# EasyEDA Pro project kuafu01_030内部老化方案.eprj, board PCB4 (continued)
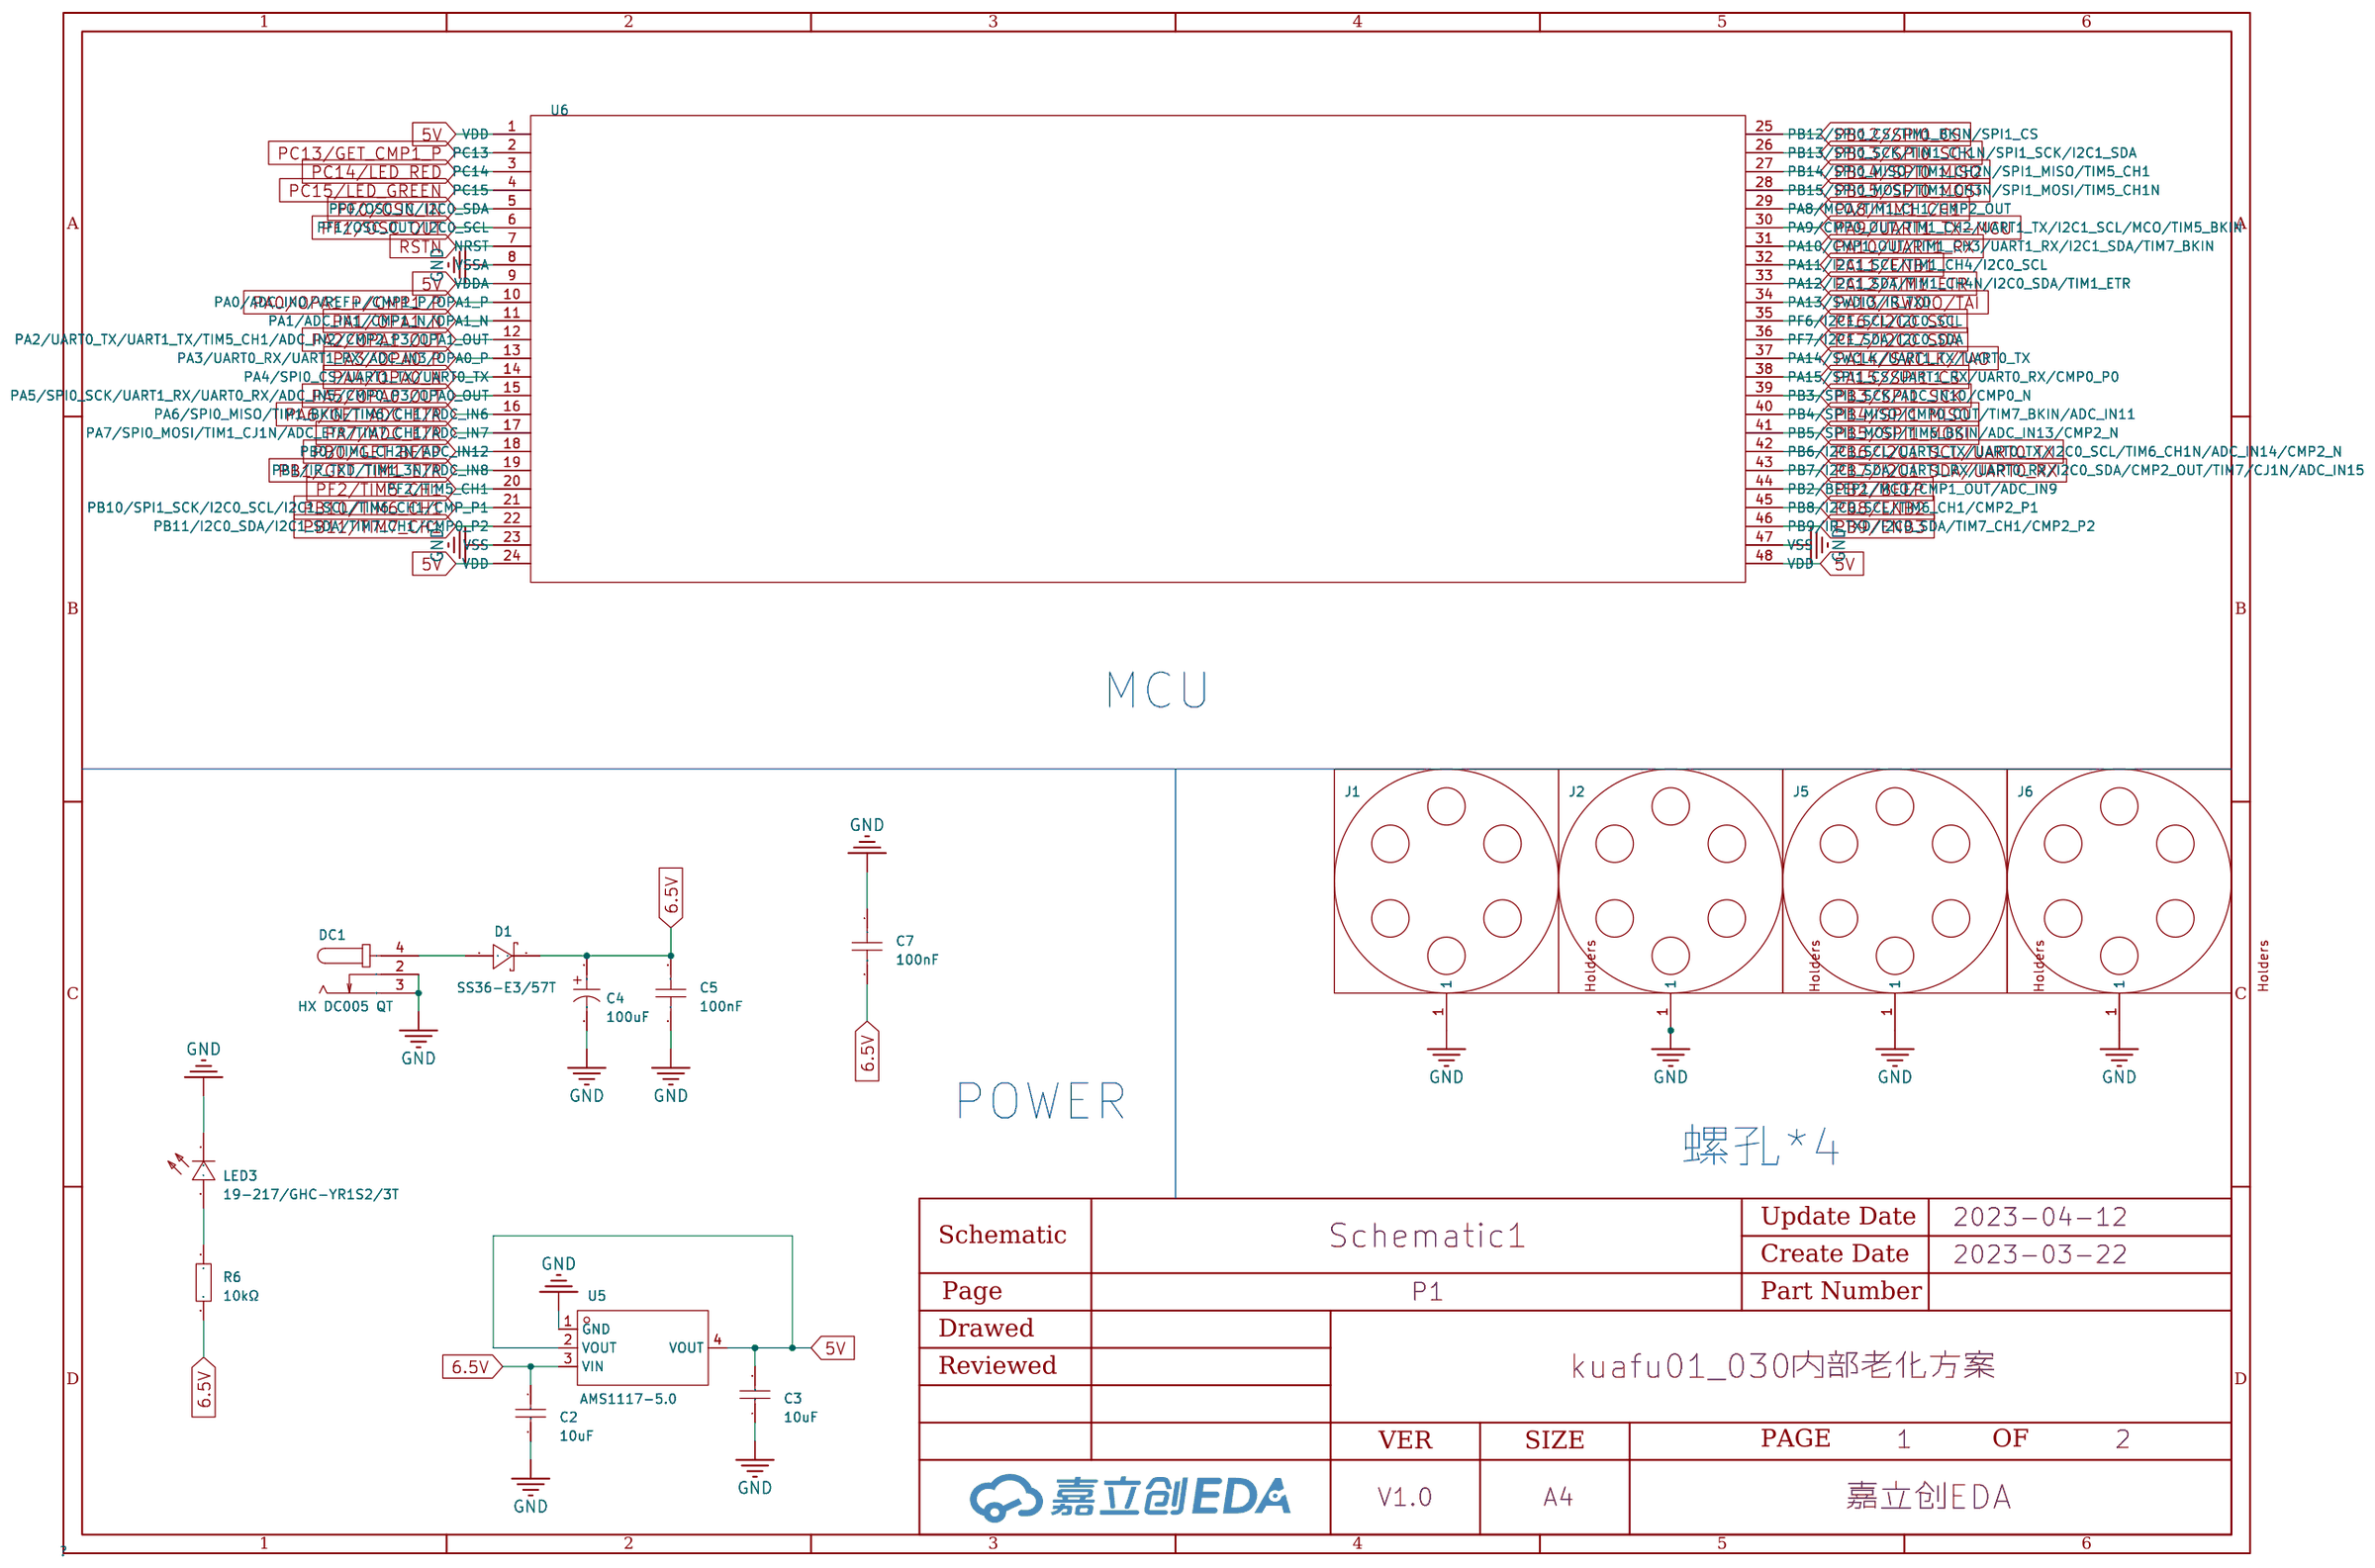
[diagram p0: P1]
## Routing (per net, layer and track width the routed paths; a pad name or vN(x,y) marks a point on that pad's centre or on a via; arc(x,y) is an arc through that point) (continued)
  Top Layer w0.508: 52.86,202.19 52.89,202.21 v1(52.89,205.81) ; 300.72,268.99 300.73,268.48 299.9,267.65 298.76,267.65 297.27,269.14 297.27,269.18 296.35,270.1 ; 300.72,268.99 300.72,268.97 ; 300.72,268.99 300.72,269.78 301.51,270.58 ; v1(254.79,250.36) 254.81,250.38 255.57,250.38 255.98,250.79 255.98,252.86 ; v1(66.08,319.86) 68.12,319.86 ; 68.12,319.86 68.12,323.17 C3#4.1 68.08,332.78 U5#3.1 ; 68.12,319.86 72.18,319.86 75.22,322.91 v1(75.22,347.8) ; v1(240.77,177.09) 239.62,178.25 239.62,178.28 ; v1(316.56,182.93) 316.25,183.24 315.44,183.24 ; 190.21,180.86 191.28,180.86 191.81,180.32 v1(192.5,180.32) ; 42.34,171.52 42.34,168.48 ; v1(203.99,250.36) 204.01,250.38 204.77,250.38 205.18,250.79 205.18,252.86 ; 245.54,222.32 245.54,219.28 ; 241.01,333.26 242.08,333.26 242.61,332.72 v1(243.3,332.72) ; v1(37.57,24.69) 36.42,25.85 36.42,25.88 ; 154.38,202.06 154.38,199.99 153.97,199.58 153.21,199.58 v1(153.19,199.56) ; 249.75,143.12 249.75,143.44 v1(248.89,144.29) ; v1(294.1,231.12) 293.41,231.12 292.88,231.66 291.81,231.66 ; 154.38,252.86 154.38,250.79 153.97,250.38 153.21,250.38 v1(153.19,250.36) ; 154.38,100.46 154.38,98.39 153.97,97.98 153.21,97.98 v1(153.19,97.96) ; 163.04,284.84 163.85,284.84 v1(164.16,284.53) ; 46.55,143.12 46.55,143.44 v1(45.69,144.29) ; 61.44,132.44 62.25,132.44 v1(62.56,132.13) ; 241.01,180.86 242.08,180.86 242.61,180.32 v1(243.3,180.32) ; 249.92,167.39 249.93,166.88 249.1,166.05 247.96,166.05 246.47,167.54 246.47,167.57 245.55,168.5 ; 249.92,167.39 249.92,168.18 250.71,168.98 ; 249.92,167.39 249.92,167.37 ; 199.12,218.19 199.13,217.68 198.3,216.85 197.16,216.85 195.67,218.34 195.67,218.38 194.75,219.3 ; 199.12,218.19 199.12,218.17 ; 199.12,218.19 199.12,218.98 199.91,219.78 ; 52.78,151.26 52.78,149.19 52.37,148.78 51.61,148.78 v1(51.59,148.76) ; 93.15,117.7 94.07,116.77 94.07,116.74 95.56,115.25 96.7,115.25 97.53,116.08 97.52,116.59 ; 97.52,14.99 97.52,14.97 ; 97.52,14.99 97.52,15.78 98.31,16.58 ; 97.52,14.99 97.53,14.48 96.7,13.65 95.56,13.65 94.07,15.14 94.07,15.18 93.15,16.1 ; 245.54,117.68 245.54,120.72 ; 198.95,143.12 198.95,143.44 v1(198.09,144.29) ; 154.46,100.59 154.49,100.61 v1(154.49,104.21) ; 213.84,284.84 214.65,284.84 v1(214.96,284.53) ; 93.14,270.08 93.14,273.12 ; 163.04,81.64 163.85,81.64 v1(164.16,81.33) ; 205.26,303.79 205.29,303.81 v1(205.29,307.41) ; 291.81,79.26 292.88,79.26 293.41,78.72 v1(294.1,78.72) ; 97.52,116.59 97.52,116.57 ; 97.52,116.59 97.52,117.38 98.31,118.18 ; v1(305.59,199.56) 305.61,199.58 306.37,199.58 306.78,199.99 306.78,202.06 ; 46.72,167.39 46.73,166.88 45.9,166.05 44.76,166.05 43.27,167.54 43.27,167.57 42.35,168.5 ; 46.72,167.39 46.72,167.37 ; 46.72,167.39 46.72,168.18 47.51,168.98 ; v1(256.09,205.81) 256.09,202.21 256.06,202.19 ; 148.32,14.99 148.32,14.97 ; 148.32,14.99 148.32,15.78 149.11,16.58 ; 148.32,14.99 148.33,14.48 147.5,13.65 146.36,13.65 144.87,15.14 144.87,15.18 143.95,16.1 ; 93.15,270.1 94.07,269.18 94.07,269.14 95.56,267.65 96.7,267.65 97.53,268.48 97.52,268.99 ; v1(139.17,227.89) 138.02,229.05 138.02,229.08 ; v1(153.19,47.16) 153.21,47.18 153.97,47.18 154.38,47.59 154.38,49.66 ; 306.78,151.26 306.78,149.19 306.37,148.78 305.61,148.78 v1(305.59,148.76) ; 57.38,341.38 54.72,341.38 ; 57.38,341.38 59.74,341.38 ; 57.38,341.38 57.38,341.38 57.38,348.52 ; 54.72,341.38 54.72,341.38 54.72,352.37 ; 54.72,341.38 40.36,341.38 37.12,344.61 37.18,349.29 ; 249.92,14.99 249.92,14.97 ; 249.92,14.99 249.93,14.48 249.1,13.65 247.96,13.65 246.47,15.14 246.47,15.18 245.55,16.1 ; 249.92,14.99 249.92,15.78 250.71,16.58 ; 148.32,218.19 148.32,218.98 149.11,219.78 ; 148.32,218.19 148.32,218.17 ; 148.32,218.19 148.33,217.68 147.5,216.85 146.36,216.85 144.87,218.34 144.87,218.38 143.95,219.3 ; v1(193.75,334.87) 195.33,334.87 v1(196.29,333.91) ; v1(139.17,75.49) 138.02,76.65 138.02,76.68 ; v1(256.09,358.21) 256.09,354.61 256.06,354.59 ; 300.54,193.92 300.54,194.24 v1(299.69,195.09) ; 306.86,100.59 306.89,100.61 v1(306.89,104.21) ; v1(254.79,199.56) 254.81,199.58 255.57,199.58 255.98,199.99 255.98,202.06 ; v1(193.75,284.07) 195.33,284.07 v1(196.29,283.11) ; 199.91,168.98 199.12,168.18 199.12,167.39 ; v1(139.17,177.09) 138.02,178.25 138.02,178.28 ; 301.51,67.38 300.72,66.58 300.72,65.79 ; 194.74,120.72 194.74,117.68 ; 296.35,117.7 297.27,116.77 297.27,116.74 298.76,115.25 299.9,115.25 300.73,116.08 300.72,116.59 ; v1(295.35,182.47) 296.93,182.47 v1(297.89,181.51) ; 315.44,284.84 316.25,284.84 v1(316.56,284.53) ; 205.18,303.66 205.18,301.59 204.77,301.18 204.01,301.18 v1(203.99,301.16) ; 194.74,171.52 194.74,168.48 ; 148.32,268.99 148.33,268.48 147.5,267.65 146.36,267.65 144.87,269.14 144.87,269.18 143.95,270.1 ; 148.32,268.99 148.32,268.97 ; 148.32,268.99 148.32,269.78 149.11,270.58 ; v1(90.9,129.52) 90.21,129.52 89.67,130.06 88.61,130.06 ; 97.52,268.99 97.52,268.97 ; 97.52,268.99 97.52,269.78 98.31,270.58 ; 296.34,117.68 296.34,120.72 ; 300.72,319.79 300.72,319.77 ; 300.72,319.79 300.73,319.28 299.9,318.45 298.76,318.45 297.27,319.94 297.27,319.97 296.35,320.9 ; 300.72,319.79 300.72,320.58 301.51,321.38 ; 255.98,49.66 255.98,47.59 255.57,47.18 254.81,47.18 v1(254.79,47.16) ; v1(139.17,278.69) 138.02,279.85 138.02,279.88 ; 194.74,219.28 194.74,222.32 ; 88.61,282.46 89.67,282.46 90.21,281.92 v1(90.9,281.92) ; 93.14,66.88 93.14,69.92 ; v1(103.69,307.41) 103.69,303.81 103.66,303.79 ; 52.86,151.39 52.89,151.41 v1(52.89,155.01) ; 239.62,330.68 239.62,330.65 v1(240.77,329.49) ; v1(244.55,284.07) 246.13,284.07 v1(247.09,283.11) ; 138.02,25.88 138.02,25.85 v1(139.17,24.69) ; v1(103.69,53.41) 103.69,49.81 103.66,49.79 ; v1(205.29,205.81) 205.29,202.21 205.26,202.19 ; 46.72,116.59 46.72,117.38 47.51,118.18 ; 46.72,116.59 46.72,116.57 ; 46.72,116.59 46.73,116.08 45.9,115.25 44.76,115.25 43.27,116.74 43.27,116.77 42.35,117.7 ; 143.95,168.5 144.87,167.57 144.87,167.54 146.36,166.05 147.5,166.05 148.33,166.88 148.32,167.39 ; 199.12,268.99 199.13,268.48 198.3,267.65 197.16,267.65 195.67,269.14 195.67,269.18 194.75,270.1 ; 199.12,268.99 199.12,268.97 ; 199.12,268.99 199.12,269.78 199.91,270.58 ; 103.58,202.06 103.58,199.99 103.17,199.58 102.41,199.58 v1(102.39,199.56) ; 250.71,67.38 249.92,66.58 249.92,65.79 ; v1(192.5,78.72) 191.81,78.72 191.28,79.26 190.21,79.26 ; 97.52,167.39 97.53,166.88 96.7,166.05 95.56,166.05 94.07,167.54 94.07,167.57 93.15,168.5 ; 97.52,167.39 97.52,168.18 98.31,168.98 ; 97.52,167.39 97.52,167.37 ; v1(297.89,79.91) 296.93,80.87 v1(295.35,80.87) ; v1(306.89,256.61) 306.89,253.01 306.86,252.99 ; v1(90.9,27.92) 90.21,27.92 89.67,28.46 88.61,28.46 ; v1(247.09,333.91) 246.13,334.87 v1(244.55,334.87) ; 97.34,193.92 97.34,194.24 v1(96.49,195.09) ; 148.32,167.39 148.32,167.37 ; 148.32,167.39 148.32,168.18 149.11,168.98 ; 163.04,30.84 163.85,30.84 v1(164.16,30.53) ; v1(256.09,155.01) 256.09,151.41 256.06,151.39 ; v1(43.89,283.11) 42.93,284.07 v1(41.35,284.07) ; 249.92,218.19 249.93,217.68 249.1,216.85 247.96,216.85 246.47,218.34 246.47,218.38 245.55,219.3 ; 249.92,218.19 249.92,218.17 ; 249.92,218.19 249.92,218.98 250.71,219.78 ; 245.54,16.08 245.54,19.12 ; 93.14,320.88 93.14,323.92 ; 291.81,282.46 292.88,282.46 293.41,281.92 v1(294.1,281.92) ; 93.14,168.48 93.14,171.52 ; v1(145.49,130.71) 144.53,131.67 v1(142.95,131.67) ; v1(51.59,199.56) 51.61,199.58 52.37,199.58 52.78,199.99 52.78,202.06 ; v1(141.7,231.12) 141.01,231.12 140.47,231.66 139.41,231.66 ; v1(294.1,129.52) 293.41,129.52 292.88,130.06 291.81,130.06 ; 66.12,358.43 66.2,358.43 ; 66.12,358.43 37.48,358.43 34.09,355.04 ; 66.12,358.43 66.12,358.42 ; 66.2,358.43 66.14,358.38 ; 66.2,358.43 67.03,358.43 ; 66.2,358.43 68.65,360.88 74.32,360.88 75.97,359.23 76.4,359.23 ; v1(196.29,181.51) 195.33,182.47 v1(193.75,182.47) ; v1(52.89,104.21) 52.89,100.61 52.86,100.59 ; v1(141.7,332.72) 141.01,332.72 140.47,333.26 139.41,333.26 ; 42.34,222.32 42.34,219.28 ; 61.44,81.64 62.25,81.64 v1(62.56,81.33) ; 87.22,279.88 87.22,279.85 v1(88.37,278.69) ; 52.54,319.86 52.54,323.39 C3#2.1 52.5,332.63 U5.1 ; 52.54,319.86 v1(50.33,319.86) ; 52.54,319.86 v1(63.54,319.86) ; v1(243.3,129.52) 242.61,129.52 242.08,130.06 241.01,130.06 ; 213.84,234.04 214.65,234.04 v1(214.96,233.73) ; v1(198.09,296.69) 198.95,295.84 198.95,295.52 ; 46.72,268.99 46.73,268.48 45.9,267.65 44.76,267.65 43.27,269.14 43.27,269.18 42.35,270.1 ; 46.72,268.99 46.72,268.97 ; 46.72,268.99 46.72,269.78 47.51,270.58 ; 143.95,117.7 144.87,116.77 144.87,116.74 146.36,115.25 147.5,115.25 148.33,116.08 148.32,116.59 ; v1(214.96,30.53) 214.65,30.84 213.84,30.84 ; 143.94,320.88 143.94,323.92 ; 37.81,282.46 38.88,282.46 39.41,281.92 v1(40.1,281.92) ; v1(243.3,281.92) 242.61,281.92 242.08,282.46 241.01,282.46 ; 112.24,132.44 113.05,132.44 v1(113.36,132.13) ; 300.72,65.79 300.73,65.28 299.9,64.45 298.76,64.45 297.27,65.94 297.27,65.97 296.35,66.9 ; 300.72,65.79 300.72,65.77 ; 198.95,193.92 198.95,194.24 v1(198.09,195.09) ; 62.54,350.58 62.54,350.58 62.54,350.58 62.54,350.58 ; 62.54,350.58 62.54,350.59 ; 46.72,218.19 46.72,218.17 ; 46.72,218.19 46.72,218.98 47.51,219.78 ; 46.72,218.19 46.73,217.68 45.9,216.85 44.76,216.85 43.27,218.34 43.27,218.38 42.35,219.3 ; 199.12,116.59 199.12,116.57 ; 199.12,116.59 199.13,116.08 198.3,115.25 197.16,115.25 195.67,116.74 195.67,116.77 194.75,117.7 ; 199.12,116.59 199.12,117.38 199.91,118.18 ; v1(40.1,231.12) 39.41,231.12 38.88,231.66 37.81,231.66 ; 300.54,92.32 300.54,92.64 v1(299.69,93.49) ; 256.06,252.99 256.09,253.01 v1(256.09,256.61) ; 264.64,335.64 265.45,335.64 v1(265.76,335.33) ; v1(316.56,233.73) 316.25,234.04 315.44,234.04 ; v1(153.19,301.16) 153.21,301.18 153.97,301.18 154.38,301.59 154.38,303.66 ; v1(102.39,250.36) 102.41,250.38 103.17,250.38 103.58,250.79 103.58,252.86 ; v1(247.09,232.31) 246.13,233.27 v1(244.55,233.27) ; 139.41,282.46 140.47,282.46 141.01,281.92 v1(141.7,281.92) ; 300.72,218.19 300.72,218.98 301.51,219.78 ; 300.72,218.19 300.73,217.68 299.9,216.85 298.76,216.85 297.27,218.34 297.27,218.38 296.35,219.3 ; 300.72,218.19 300.72,218.17 ; 62.54,350.59 62.54,350.6 62.55,350.6 62.54,350.59 ; v1(248.89,42.69) 249.75,41.84 249.75,41.52 ; v1(52.89,53.41) 52.89,49.81 52.86,49.79 ; 143.94,120.72 143.94,117.68 ; 249.92,319.79 249.92,320.58 250.71,321.38 ; 249.92,319.79 249.92,319.77 ; 249.92,319.79 249.93,319.28 249.1,318.45 247.96,318.45 246.47,319.94 246.47,319.97 245.55,320.9 ; 249.92,116.59 249.92,116.57 ; 249.92,116.59 249.92,117.38 250.71,118.18 ; 249.92,116.59 249.93,116.08 249.1,115.25 247.96,115.25 246.47,116.74 246.47,116.77 245.55,117.7 ; v1(102.39,351.96) 102.41,351.98 103.17,351.98 103.58,352.39 103.58,354.46 ; v1(297.89,130.71) 296.93,131.67 v1(295.35,131.67) ; 306.86,151.39 306.89,151.41 v1(306.89,155.01) ; 296.34,69.92 296.34,66.88 ; 103.66,354.59 103.69,354.61 v1(103.69,358.21) ; v1(103.69,104.21) 103.69,100.61 103.66,100.59 ; 46.72,65.79 46.72,66.58 47.51,67.38 ; 46.72,65.79 46.72,65.77 ; 46.72,65.79 46.73,65.28 45.9,64.45 44.76,64.45 43.27,65.94 43.27,65.97 42.35,66.9 ; 42.34,19.12 42.34,16.08 ; 249.92,65.79 249.93,65.28 249.1,64.45 247.96,64.45 246.47,65.94 246.47,65.97 245.55,66.9 ; 249.92,65.79 249.92,65.77 ; v1(205.29,53.41) 205.29,49.81 205.26,49.79 ; 143.94,222.32 143.94,219.28 ; 194.74,16.08 194.74,19.12 ; 290.42,279.88 290.42,279.85 v1(291.57,278.69) ; v1(203.99,148.76) 204.01,148.78 204.77,148.78 205.18,149.19 205.18,151.26 ; 255.98,100.46 255.98,98.39 255.57,97.98 254.81,97.98 v1(254.79,97.96) ; v1(45.69,93.49) 46.55,92.64 46.55,92.32 ; 239.62,229.08 239.62,229.05 v1(240.77,227.89) ; v1(316.56,132.13) 316.25,132.44 315.44,132.44 ; 42.34,120.72 42.34,117.68 ; 306.78,100.46 306.78,98.39 306.37,97.98 305.61,97.98 v1(305.59,97.96) ; v1(295.35,233.27) 296.93,233.27 v1(297.89,232.31) ; 199.12,167.39 199.13,166.88 198.3,166.05 197.16,166.05 195.67,167.54 195.67,167.57 194.75,168.5 ; 199.12,167.39 199.12,167.37 ; 148.32,65.79 148.32,65.77 ; 148.32,65.79 148.32,66.58 149.11,67.38 ; 148.32,65.79 148.33,65.28 147.5,64.45 146.36,64.45 144.87,65.94 144.87,65.97 143.95,66.9 ; 213.84,132.44 214.65,132.44 v1(214.96,132.13) ; v1(90.9,332.72) 90.21,332.72 89.67,333.26 88.61,333.26 ; 42.34,66.88 42.34,69.92 ; 213.84,81.64 214.65,81.64 v1(214.96,81.33) ; 88.61,231.66 89.67,231.66 90.21,231.12 v1(90.9,231.12) ; v1(316.56,335.33) 316.25,335.64 315.44,335.64 ; v1(295.35,284.07) 296.93,284.07 v1(297.89,283.11) ; v1(37.57,278.69) 36.42,279.85 36.42,279.88 ; v1(103.69,155.01) 103.69,151.41 103.66,151.39 ; 194.75,16.1 195.67,15.18 195.67,15.14 197.16,13.65 198.3,13.65 199.13,14.48 199.12,14.99 ; 52.78,49.66 52.78,47.59 52.37,47.18 51.61,47.18 v1(51.59,47.16) ; v1(154.49,256.61) 154.49,253.01 154.46,252.99 ; 143.94,19.12 143.94,16.08 ; 205.18,202.06 205.18,199.99 204.77,199.58 204.01,199.58 v1(203.99,199.56) ; 143.94,171.52 143.94,168.48 ; 194.74,270.08 194.74,273.12 ; v1(145.49,79.91) 144.53,80.87 v1(142.95,80.87) ; 249.75,193.92 249.75,194.24 v1(248.89,195.09) ; v1(113.36,30.53) 113.05,30.84 112.24,30.84 ; 37.18,349.29 37.18,349.71 33.91,352.98 33.91,353.7 ; 37.18,349.29 37.18,349.18 37.22,349.14 ; v1(41.35,30.07) 42.93,30.07 v1(43.89,29.11) ; 198.95,346.32 198.95,346.64 v1(198.09,347.49) ; v1(248.89,347.49) 249.75,346.64 249.75,346.32 ; 148.32,319.79 148.32,319.77 ; 148.32,319.79 148.33,319.28 147.5,318.45 146.36,318.45 144.87,319.94 144.87,319.97 143.95,320.9 ; 148.32,319.79 148.32,320.58 149.11,321.38 ; 296.34,323.92 296.34,320.88 ; 42.34,270.08 42.34,273.12 ; v1(45.69,245.89) 46.55,245.04 46.55,244.72 ; 300.54,295.52 300.54,295.84 v1(299.69,296.69) ; v1(92.15,284.07) 93.73,284.07 v1(94.69,283.11) ; 36.42,76.68 36.42,76.65 v1(37.57,75.49) ; 205.26,151.39 205.29,151.41 v1(205.29,155.01) ; 42.35,16.1 43.27,15.18 43.27,15.14 44.76,13.65 45.9,13.65 46.73,14.48 46.72,14.99 ; 46.55,41.52 46.55,41.84 v1(45.69,42.69) ; 148.32,116.59 148.32,117.38 149.11,118.18 ; 148.32,116.59 148.32,116.57 ; 148.15,41.52 148.15,41.84 v1(147.29,42.69) ; v1(145.49,333.91) 144.53,334.87 v1(142.95,334.87) ; 194.74,323.92 194.74,320.88 ; v1(154.49,307.41) 154.49,303.81 154.46,303.79 ; 138.02,127.48 138.02,127.45 v1(139.17,126.29) ; v1(145.49,283.11) 144.53,284.07 v1(142.95,284.07) ; 256.06,49.79 256.09,49.81 v1(256.09,53.41) ; v1(192.5,281.92) 191.81,281.92 191.28,282.46 190.21,282.46 ; 264.64,81.64 265.45,81.64 v1(265.76,81.33) ; v1(306.89,205.81) 306.89,202.21 306.86,202.19 ; 239.62,25.88 239.62,25.85 v1(240.77,24.69) ; v1(203.99,351.96) 204.01,351.98 204.77,351.98 205.18,352.39 205.18,354.46 ; v1(247.09,130.71) 246.13,131.67 v1(244.55,131.67) ; 213.84,335.64 214.65,335.64 v1(214.96,335.33) ; 301.51,168.98 300.72,168.18 300.72,167.39 ; 205.26,252.99 205.29,253.01 v1(205.29,256.61) ; v1(164.16,132.13) 163.85,132.44 163.04,132.44 ; 97.34,346.32 97.34,346.64 v1(96.49,347.49) ; v1(141.7,129.52) 141.01,129.52 140.47,130.06 139.41,130.06 ; v1(189.97,329.49) 188.82,330.65 188.82,330.68 ; v1(113.36,81.33) 113.05,81.64 112.24,81.64 ; v1(96.49,42.69) 97.34,41.84 97.34,41.52 ; 97.52,218.19 97.52,218.98 98.31,219.78 ; 97.52,218.19 97.53,217.68 96.7,216.85 95.56,216.85 94.07,218.34 94.07,218.38 93.15,219.3 ; 97.52,218.19 97.52,218.17 ; v1(103.69,256.61) 103.69,253.01 103.66,252.99 ; 61.44,30.84 62.25,30.84 v1(62.56,30.53) ; v1(316.56,81.33) 316.25,81.64 315.44,81.64 ; v1(265.76,233.73) 265.45,234.04 264.64,234.04 ; 199.12,319.79 199.13,319.28 198.3,318.45 197.16,318.45 195.67,319.94 195.67,319.97 194.75,320.9 ; 199.12,319.79 199.12,319.77 ; 199.12,319.79 199.12,320.58 199.91,321.38 ; v1(52.89,256.61) 52.89,253.01 52.86,252.99 ; v1(40.1,78.72) 39.41,78.72 38.88,79.26 37.81,79.26 ; 103.58,49.66 103.58,47.59 103.17,47.18 102.41,47.18 v1(102.39,47.16) ; 300.54,143.12 300.54,143.44 v1(299.69,144.29) ; v1(92.15,334.87) 93.73,334.87 v1(94.69,333.91) ; v1(244.55,30.07) 246.13,30.07 v1(247.09,29.11) ; v1(254.79,351.96) 254.81,351.98 255.57,351.98 255.98,352.39 255.98,354.46 ; v1(41.35,182.47) 42.93,182.47 v1(43.89,181.51) ; 264.64,183.24 265.45,183.24 v1(265.76,182.93) ; v1(244.55,80.87) 246.13,80.87 v1(247.09,79.91) ; 296.35,168.5 297.27,167.57 297.27,167.54 298.76,166.05 299.9,166.05 300.73,166.88 300.72,167.39 ; v1(103.69,205.81) 103.69,202.21 103.66,202.19 ; 301.51,118.18 300.72,117.38 300.72,116.59 ; 143.94,66.88 143.94,69.92 ; 213.84,183.24 214.65,183.24 v1(214.96,182.93) ; v1(40.1,180.32) 39.41,180.32 38.88,180.86 37.81,180.86 ; 112.24,183.24 113.05,183.24 v1(113.36,182.93) ; 139.41,79.26 140.47,79.26 141.01,78.72 v1(141.7,78.72) ; 199.12,65.79 199.13,65.28 198.3,64.45 197.16,64.45 195.67,65.94 195.67,65.97 194.75,66.9 ; 199.12,65.79 199.12,66.58 199.91,67.38 ; 199.12,65.79 199.12,65.77 ; v1(45.69,195.09) 46.55,194.24 46.55,193.92 ; 112.24,335.64 113.05,335.64 v1(113.36,335.33) ; v1(88.37,75.49) 87.22,76.65 87.22,76.68 ; v1(145.49,29.11) 144.53,30.07 v1(142.95,30.07) ; 61.44,183.24 62.25,183.24 v1(62.56,182.93) ; 87.22,25.88 87.22,25.85 v1(88.37,24.69) ; 205.18,49.66 205.18,47.59 204.77,47.18 204.01,47.18 v1(203.99,47.16) ; v1(254.79,301.16) 254.81,301.18 255.57,301.18 255.98,301.59 255.98,303.66 ; v1(193.75,30.07) 195.33,30.07 v1(196.29,29.11) ; 148.15,295.52 148.15,295.84 v1(147.29,296.69) ; 112.24,284.84 113.05,284.84 v1(113.36,284.53) ; v1(189.97,126.29) 188.82,127.45 188.82,127.48 ; v1(51.59,301.16) 51.61,301.18 52.37,301.18 52.78,301.59 52.78,303.66 ; 37.81,28.46 38.88,28.46 39.41,27.92 v1(40.1,27.92) ; 52.86,303.79 52.89,303.81 v1(52.89,307.41) ; v1(154.49,155.01) 154.49,151.41 154.46,151.39 ; v1(145.49,181.51) 144.53,182.47 v1(142.95,182.47) ; v1(189.97,278.69) 188.82,279.85 188.82,279.88 ; 52.78,252.86 52.78,250.79 52.37,250.38 51.61,250.38 v1(51.59,250.36) ; 245.54,168.48 245.54,171.52 ; 306.86,354.59 306.89,354.61 v1(306.89,358.21) ; v1(265.76,284.53) 265.45,284.84 264.64,284.84 ; v1(88.37,227.89) 87.22,229.05 87.22,229.08 ; 46.55,295.52 46.55,295.84 v1(45.69,296.69) ; 256.06,100.59 256.09,100.61 v1(256.09,104.21) ; v1(193.75,233.27) 195.33,233.27 v1(196.29,232.31) ; 245.54,69.92 245.54,66.88 ; 198.95,41.52 198.95,41.84 v1(198.09,42.69) ; v1(203.99,97.96) 204.01,97.98 204.77,97.98 205.18,98.39 205.18,100.46 ; 148.15,143.12 148.15,143.44 v1(147.29,144.29) ; 62.54,350.57 62.54,350.57 62.54,342.8 61.12,341.38 59.74,341.38 ; v1(205.29,358.21) 205.29,354.61 205.26,354.59 ; v1(306.89,307.41) 306.89,303.81 306.86,303.79 ; v1(154.49,53.41) 154.49,49.81 154.46,49.79 ; v1(305.59,301.16) 305.61,301.18 306.37,301.18 306.78,301.59 306.78,303.66 ; 296.34,219.28 296.34,222.32 ; v1(96.49,144.29) 97.34,143.44 97.34,143.12 ; 249.92,268.99 249.92,268.97 ; 249.92,268.99 249.93,268.48 249.1,267.65 247.96,267.65 246.47,269.14 246.47,269.18 245.55,270.1 ; 249.92,268.99 249.92,269.78 250.71,270.58 ; 256.06,303.79 256.09,303.81 v1(256.09,307.41) ; v1(295.35,334.87) 296.93,334.87 v1(297.89,333.91) ; v1(37.57,177.09) 36.42,178.25 36.42,178.28 ; 245.54,273.12 245.54,270.08 ; 300.72,167.39 300.72,167.37 ; 290.42,229.08 290.42,229.05 v1(291.57,227.89) ; v1(96.49,245.89) 97.34,245.04 97.34,244.72 ; 148.15,193.92 148.15,194.24 v1(147.29,195.09) ; 97.52,319.79 97.53,319.28 96.7,318.45 95.56,318.45 94.07,319.94 94.07,319.97 93.15,320.9 ; 97.52,319.79 97.52,319.77 ; 97.52,319.79 97.52,320.58 98.31,321.38 ; v1(90.9,180.32) 90.21,180.32 89.67,180.86 88.61,180.86 ; 93.14,222.32 93.14,219.28 ; 190.21,130.06 191.28,130.06 191.81,129.52 v1(192.5,129.52) ; 194.74,66.88 194.74,69.92 ; v1(147.29,93.49) 148.15,92.64 148.15,92.32 ; 143.94,270.08 143.94,273.12 ; 291.81,180.86 292.88,180.86 293.41,180.32 v1(294.1,180.32) ; 148.15,244.72 148.15,245.04 v1(147.29,245.89) ; 198.95,92.32 198.95,92.64 v1(198.09,93.49) ; v1(192.5,332.72) 191.81,332.72 191.28,333.26 190.21,333.26 ; v1(254.79,148.76) 254.81,148.78 255.57,148.78 255.98,149.19 255.98,151.26 ; v1(43.89,232.31) 42.93,233.27 v1(41.35,233.27) ; v1(62.56,233.73) 62.25,234.04 61.44,234.04 ; 190.21,231.66 191.28,231.66 191.81,231.12 v1(192.5,231.12) ; 139.41,28.46 140.47,28.46 141.01,27.92 v1(141.7,27.92) ; v1(153.19,351.96) 153.21,351.98 153.97,351.98 154.38,352.39 154.38,354.46 ; v1(96.49,93.49) 97.34,92.64 97.34,92.32 ; v1(291.57,177.09) 290.42,178.25 290.42,178.28 ; v1(196.29,130.71) 195.33,131.67 v1(193.75,131.67) ; 290.42,127.48 290.42,127.45 v1(291.57,126.29) ; 296.34,273.12 296.34,270.08 ; v1(41.35,80.87) 42.93,80.87 v1(43.89,79.91) ; v1(92.15,233.27) 93.73,233.27 v1(94.69,232.31) ; 46.72,14.99 46.72,14.97 ; 46.72,14.99 46.72,15.78 47.51,16.58 ; v1(94.69,29.11) 93.73,30.07 v1(92.15,30.07) ; U5#4.1 36.82,332.79 C3.1 40.77,319.86 v1(47.79,319.86) ; 154.46,202.19 154.49,202.21 v1(154.49,205.81) ; 87.22,330.68 87.22,330.65 v1(88.37,329.49) ; v1(51.59,97.96) 51.61,97.98 52.37,97.98 52.78,98.39 52.78,100.46 ; 59.73,352.37 59.73,341.38 59.74,341.38 ; 300.54,244.72 300.54,245.04 v1(299.69,245.89) ; v1(88.37,126.29) 87.22,127.45 87.22,127.48 ; 87.22,178.28 87.22,178.25 v1(88.37,177.09) ; 98.31,67.38 97.52,66.58 97.52,65.79 ; 103.58,303.66 103.58,301.59 103.17,301.18 102.41,301.18 v1(102.39,301.16) ; v1(265.76,30.53) 265.45,30.84 264.64,30.84 ; 97.34,295.52 97.34,295.84 v1(96.49,296.69) ; 103.58,151.26 103.58,149.19 103.17,148.78 102.41,148.78 v1(102.39,148.76) ; v1(62.56,284.53) 62.25,284.84 61.44,284.84 ; 139.41,180.86 140.47,180.86 141.01,180.32 v1(141.7,180.32) ; 296.34,171.52 296.34,168.48 ; v1(291.57,329.49) 290.42,330.65 290.42,330.68 ; 249.75,244.72 249.75,245.04 v1(248.89,245.89) ; 205.26,100.59 205.29,100.61 v1(205.29,104.21) ; v1(92.15,80.87) 93.73,80.87 v1(94.69,79.91) ; v1(164.16,335.33) 163.85,335.64 163.04,335.64 ; v1(94.69,130.71) 93.73,131.67 v1(92.15,131.67) ; 37.81,130.06 38.88,130.06 39.41,129.52 v1(40.1,129.52) ; v1(154.49,358.21) 154.49,354.61 154.46,354.59 ; 198.95,244.72 198.95,245.04 v1(198.09,245.89) ; 239.62,127.48 239.62,127.45 v1(240.77,126.29) ; v1(243.3,78.72) 242.61,78.72 242.08,79.26 241.01,79.26 ; v1(153.19,148.76) 153.21,148.78 153.97,148.78 154.38,149.19 154.38,151.26 ; 300.72,116.59 300.72,116.57 ; v1(265.76,132.13) 265.45,132.44 264.64,132.44 ; 300.54,346.32 300.54,346.64 v1(299.69,347.49) ; 148.15,346.32 148.15,346.64 v1(147.29,347.49) ; v1(145.49,232.31) 144.53,233.27 v1(142.95,233.27) ; 190.21,28.46 191.28,28.46 191.81,27.92 v1(192.5,27.92) ; 188.82,178.28 188.82,178.25 v1(189.97,177.09) ; v1(90.9,78.72) 90.21,78.72 89.67,79.26 88.61,79.26 ; 245.54,320.88 245.54,323.92 ; 199.12,14.99 199.12,15.78 199.91,16.58 ; 199.12,14.99 199.12,14.97 ; 239.62,279.88 239.62,279.85 v1(240.77,278.69) ; v1(305.59,250.36) 305.61,250.38 306.37,250.38 306.78,250.79 306.78,252.86 ; v1(92.15,182.47) 93.73,182.47 v1(94.69,181.51) ; 163.04,183.24 163.85,183.24 v1(164.16,182.93) ; 97.52,65.79 97.53,65.28 96.7,64.45 95.56,64.45 94.07,65.94 94.07,65.97 93.15,66.9 ; 97.52,65.79 97.52,65.77 ; v1(102.39,97.96) 102.41,97.98 103.17,97.98 103.58,98.39 103.58,100.46 ; 112.24,234.04 113.05,234.04 v1(113.36,233.73) ; v1(41.35,131.67) 42.93,131.67 v1(43.89,130.71) ; 36.42,127.48 36.42,127.45 v1(37.57,126.29) ; v1(247.09,181.51) 246.13,182.47 v1(244.55,182.47) ; 291.81,333.26 292.88,333.26 293.41,332.72 v1(294.1,332.72) ; 249.75,92.32 249.75,92.64 v1(248.89,93.49) ; C3#3.1 81.28,359.19 v1(81.28,359.16) ; v1(37.57,227.89) 36.42,229.05 36.42,229.08 ; 239.62,76.68 239.62,76.65 v1(240.77,75.49) ; 306.78,354.46 306.78,352.39 306.37,351.98 305.61,351.98 v1(305.59,351.96) ; 241.01,28.46 242.08,28.46 242.61,27.92 v1(243.3,27.92) ; 93.14,120.72 93.14,117.68 ; 188.82,25.88 188.82,25.85 v1(189.97,24.69) ; v1(196.29,79.91) 195.33,80.87 v1(193.75,80.87) ; 163.04,234.04 163.85,234.04 v1(164.16,233.73) ; 188.82,229.08 188.82,229.05 v1(189.97,227.89) ; 290.42,76.68 290.42,76.65 v1(291.57,75.49) ; v1(139.17,329.49) 138.02,330.65 138.02,330.68 ; 249.75,295.52 249.75,295.84 v1(248.89,296.69) ; v1(243.3,231.12) 242.61,231.12 242.08,231.66 241.01,231.66 ; v1(189.97,75.49) 188.82,76.65 188.82,76.68 ; 93.14,19.12 93.14,16.08
  Bottom Layer w0.381: v1(95.11,242.04) 95.11,244.61 v1(98.94,248.43) ; v1(149.74,45.23) 145.91,41.41 v1(145.91,38.84) ; v1(251.34,45.23) 247.51,41.41 v1(247.51,38.84) ; v1(240.77,177.09) 241.71,176.16 241.71,174.77 v1(243.03,173.44) ; v1(148.01,36.37) 148.05,36.37 148.69,35.74 148.69,34.16 149.61,33.23 ; 251.21,287.23 250.29,288.16 250.29,289.74 249.65,290.37 v1(249.61,290.37) ; v1(44.31,89.64) 44.31,92.21 v1(48.13,96.03) ; v1(139.17,24.69) 140.11,23.76 140.11,22.37 v1(141.43,21.04) ; v1(249.61,188.77) 249.65,188.77 250.29,188.14 250.29,186.56 251.21,185.63 ; v1(46.41,239.57) 46.45,239.57 47.09,238.94 47.09,237.36 48.01,236.43 ; v1(192.23,71.84) 190.91,73.17 190.91,74.56 v1(189.97,75.49) ; v1(240.77,329.49) 241.71,328.56 241.71,327.17 v1(243.03,325.84) ; v1(39.83,122.64) 38.51,123.97 38.51,125.36 v1(37.57,126.29) ; v1(149.74,96.03) 145.91,92.21 v1(145.91,89.64) ; v1(95.11,292.84) 95.11,295.41 v1(98.94,299.23) ; v1(300.41,87.17) 300.45,87.17 301.09,86.54 301.09,84.96 302.01,84.03 ; v1(48.13,197.63) 44.31,193.81 v1(44.31,191.24) ; 302.01,236.43 301.09,237.36 301.09,238.94 300.45,239.57 v1(300.41,239.57) ; v1(139.17,329.49) 140.11,328.56 140.11,327.17 v1(141.43,325.84) ; v1(44.31,242.04) 44.31,244.61 v1(48.13,248.43) ; v1(300.41,341.17) 300.45,341.17 301.09,340.54 301.09,338.96 302.01,338.03 ; v1(240.77,278.69) 241.71,277.76 241.71,276.37 v1(243.03,275.04) ; v1(48.13,45.23) 44.31,41.41 v1(44.31,38.84) ; v1(196.71,89.64) 196.71,92.21 v1(200.53,96.03) ; v1(196.71,38.84) 196.71,41.41 v1(200.53,45.23) ; 200.41,287.23 199.49,288.16 199.49,289.74 198.85,290.37 v1(198.81,290.37) ; v1(37.57,227.89) 38.51,226.96 38.51,225.57 v1(39.83,224.24) ; 251.21,84.03 250.29,84.96 250.29,86.54 249.65,87.17 v1(249.61,87.17) ; v1(189.97,24.69) 190.91,23.76 190.91,22.37 v1(192.23,21.04) ; v1(298.31,191.24) 298.31,193.81 v1(302.13,197.63) ; v1(48.13,299.23) 44.31,295.41 v1(44.31,292.84) ; v1(240.77,227.89) 241.71,226.96 241.71,225.57 v1(243.03,224.24) ; v1(39.83,21.04) 38.51,22.37 38.51,23.76 v1(37.57,24.69) ; v1(247.51,191.24) 247.51,193.81 v1(251.34,197.63) ; v1(240.77,126.29) 241.71,125.36 241.71,123.97 v1(243.03,122.64) ; 98.81,338.03 97.89,338.96 97.89,340.54 97.25,341.17 v1(97.21,341.17) ; v1(139.17,126.29) 140.11,125.36 140.11,123.97 v1(141.43,122.64) ; v1(39.83,275.04) 38.51,276.37 38.51,277.76 v1(37.57,278.69) ; v1(97.21,290.37) 97.25,290.37 97.89,289.74 97.89,288.16 98.81,287.23 ; v1(149.74,299.23) 145.91,295.41 v1(145.91,292.84) ; 302.01,185.63 301.09,186.56 301.09,188.14 300.45,188.77 v1(300.41,188.77) ; v1(300.41,137.97) 300.45,137.97 301.09,137.34 301.09,135.76 302.01,134.83 ; v1(88.37,177.09) 89.31,176.16 89.31,174.77 v1(90.63,173.44) ; v1(200.53,299.23) 196.71,295.41 v1(196.71,292.84) ; v1(293.83,224.24) 292.51,225.57 292.51,226.96 v1(291.57,227.89) ; v1(198.81,36.37) 198.85,36.37 199.49,35.74 199.49,34.16 200.41,33.23 ; 98.81,134.83 97.89,135.76 97.89,137.34 97.25,137.97 v1(97.21,137.97) ; v1(196.71,140.44) 196.71,143.01 v1(200.53,146.83) ; 200.41,84.03 199.49,84.96 199.49,86.54 198.85,87.17 v1(198.81,87.17) ; v1(291.57,126.29) 292.51,125.36 292.51,123.97 v1(293.83,122.64) ; v1(200.53,197.63) 196.71,193.81 v1(196.71,191.24) ; v1(189.97,126.29) 190.91,125.36 190.91,123.97 v1(192.23,122.64) ; v1(88.37,126.29) 89.31,125.36 89.31,123.97 v1(90.63,122.64) ; v1(243.03,21.04) 241.71,22.37 241.71,23.76 v1(240.77,24.69) ; v1(88.37,329.49) 89.31,328.56 89.31,327.17 v1(90.63,325.84) ; v1(141.43,224.24) 140.11,225.57 140.11,226.96 v1(139.17,227.89) ; v1(37.57,177.09) 38.51,176.16 38.51,174.77 v1(39.83,173.44) ; v1(293.83,275.04) 292.51,276.37 292.51,277.76 v1(291.57,278.69) ; v1(302.13,248.43) 298.31,244.61 v1(298.31,242.04) ; v1(44.31,140.44) 44.31,143.01 v1(48.13,146.83) ; v1(291.57,329.49) 292.51,328.56 292.51,327.17 v1(293.83,325.84) ; v1(46.41,87.17) 46.45,87.17 47.09,86.54 47.09,84.96 48.01,84.03 ; v1(302.13,96.03) 298.31,92.21 v1(298.31,89.64) ; v1(95.11,140.44) 95.11,143.01 v1(98.94,146.83) ; v1(88.37,227.89) 89.31,226.96 89.31,225.57 v1(90.63,224.24) ; v1(95.11,191.24) 95.11,193.81 v1(98.94,197.63) ; v1(249.61,341.17) 249.65,341.17 250.29,340.54 250.29,338.96 251.21,338.03 ; v1(98.94,350.03) 95.11,346.21 v1(95.11,343.64) ; v1(249.61,137.97) 249.65,137.97 250.29,137.34 250.29,135.76 251.21,134.83 ; v1(302.13,350.03) 298.31,346.21 v1(298.31,343.64) ; 149.61,287.23 148.69,288.16 148.69,289.74 148.05,290.37 v1(148.01,290.37) ; v1(251.34,146.83) 247.51,143.01 v1(247.51,140.44) ; v1(192.23,224.24) 190.91,225.57 190.91,226.96 v1(189.97,227.89) ; v1(291.57,75.49) 292.51,74.56 292.51,73.17 v1(293.83,71.84) ; 48.01,134.83 47.09,135.76 47.09,137.34 46.45,137.97 v1(46.41,137.97) ; 149.61,185.63 148.69,186.56 148.69,188.14 148.05,188.77 v1(148.01,188.77) ; v1(251.34,350.03) 247.51,346.21 v1(247.51,343.64) ; v1(198.81,137.97) 198.85,137.97 199.49,137.34 199.49,135.76 200.41,134.83 ; v1(46.41,36.37) 46.45,36.37 47.09,35.74 47.09,34.16 48.01,33.23 ; 98.81,33.23 97.89,34.16 97.89,35.74 97.25,36.37 v1(97.21,36.37) ; v1(302.13,299.23) 298.31,295.41 v1(298.31,292.84) ; v1(243.03,71.84) 241.71,73.17 241.71,74.56 v1(240.77,75.49) ; v1(189.97,278.69) 190.91,277.76 190.91,276.37 v1(192.23,275.04) ; v1(247.51,89.64) 247.51,92.21 v1(251.34,96.03) ; v1(141.43,173.44) 140.11,174.77 140.11,176.16 v1(139.17,177.09) ; 149.61,134.83 148.69,135.76 148.69,137.34 148.05,137.97 v1(148.01,137.97) ; v1(291.57,177.09) 292.51,176.16 292.51,174.77 v1(293.83,173.44) ; v1(148.01,87.17) 148.05,87.17 148.69,86.54 148.69,84.96 149.61,84.03 ; 200.41,338.03 199.49,338.96 199.49,340.54 198.85,341.17 v1(198.81,341.17) ; v1(251.34,248.43) 247.51,244.61 v1(247.51,242.04) ; v1(145.91,343.64) 145.91,346.21 v1(149.74,350.03) ; v1(247.51,292.84) 247.51,295.41 v1(251.34,299.23) ; v1(139.17,278.69) 140.11,277.76 140.11,276.37 v1(141.43,275.04) ; v1(189.97,177.09) 190.91,176.16 190.91,174.77 v1(192.23,173.44) ; v1(39.83,71.84) 38.51,73.17 38.51,74.56 v1(37.57,75.49) ; 98.81,185.63 97.89,186.56 97.89,188.14 97.25,188.77 v1(97.21,188.77) ; 98.81,84.03 97.89,84.96 97.89,86.54 97.25,87.17 v1(97.21,87.17) ; v1(149.74,146.83) 145.91,143.01 v1(145.91,140.44) ; v1(90.63,71.84) 89.31,73.17 89.31,74.56 v1(88.37,75.49) ; v1(249.61,36.37) 249.65,36.37 250.29,35.74 250.29,34.16 251.21,33.23 ; 200.41,185.63 199.49,186.56 199.49,188.14 198.85,188.77 v1(198.81,188.77) ; v1(149.74,248.43) 145.91,244.61 v1(145.91,242.04) ; v1(200.53,248.43) 196.71,244.61 v1(196.71,242.04) ; 200.41,236.43 199.49,237.36 199.49,238.94 198.85,239.57 v1(198.81,239.57) ; v1(148.01,239.57) 148.05,239.57 148.69,238.94 148.69,237.36 149.61,236.43 ; 48.01,185.63 47.09,186.56 47.09,188.14 46.45,188.77 v1(46.41,188.77) ; v1(98.94,45.23) 95.11,41.41 v1(95.11,38.84) ; v1(149.74,197.63) 145.91,193.81 v1(145.91,191.24) ; v1(196.71,343.64) 196.71,346.21 v1(200.53,350.03) ; v1(189.97,329.49) 190.91,328.56 190.91,327.17 v1(192.23,325.84) ; v1(298.31,140.44) 298.31,143.01 v1(302.13,146.83) ; v1(88.37,24.69) 89.31,23.76 89.31,22.37 v1(90.63,21.04) ; 48.01,287.23 47.09,288.16 47.09,289.74 46.45,290.37 v1(46.41,290.37) ; v1(98.94,96.03) 95.11,92.21 v1(95.11,89.64) ; v1(139.17,75.49) 140.11,74.56 140.11,73.17 v1(141.43,71.84) ; v1(90.63,275.04) 89.31,276.37 89.31,277.76 v1(88.37,278.69) ; v1(249.61,239.57) 249.65,239.57 250.29,238.94 250.29,237.36 251.21,236.43 ; 98.81,236.43 97.89,237.36 97.89,238.94 97.25,239.57 v1(97.21,239.57) ; v1(300.41,290.37) 300.45,290.37 301.09,289.74 301.09,288.16 302.01,287.23 ; 149.61,338.03 148.69,338.96 148.69,340.54 148.05,341.17 v1(148.01,341.17)